# EasyEDA Pro project kuafu01_030内部老化方案.eprj, board PCB4 (continued)
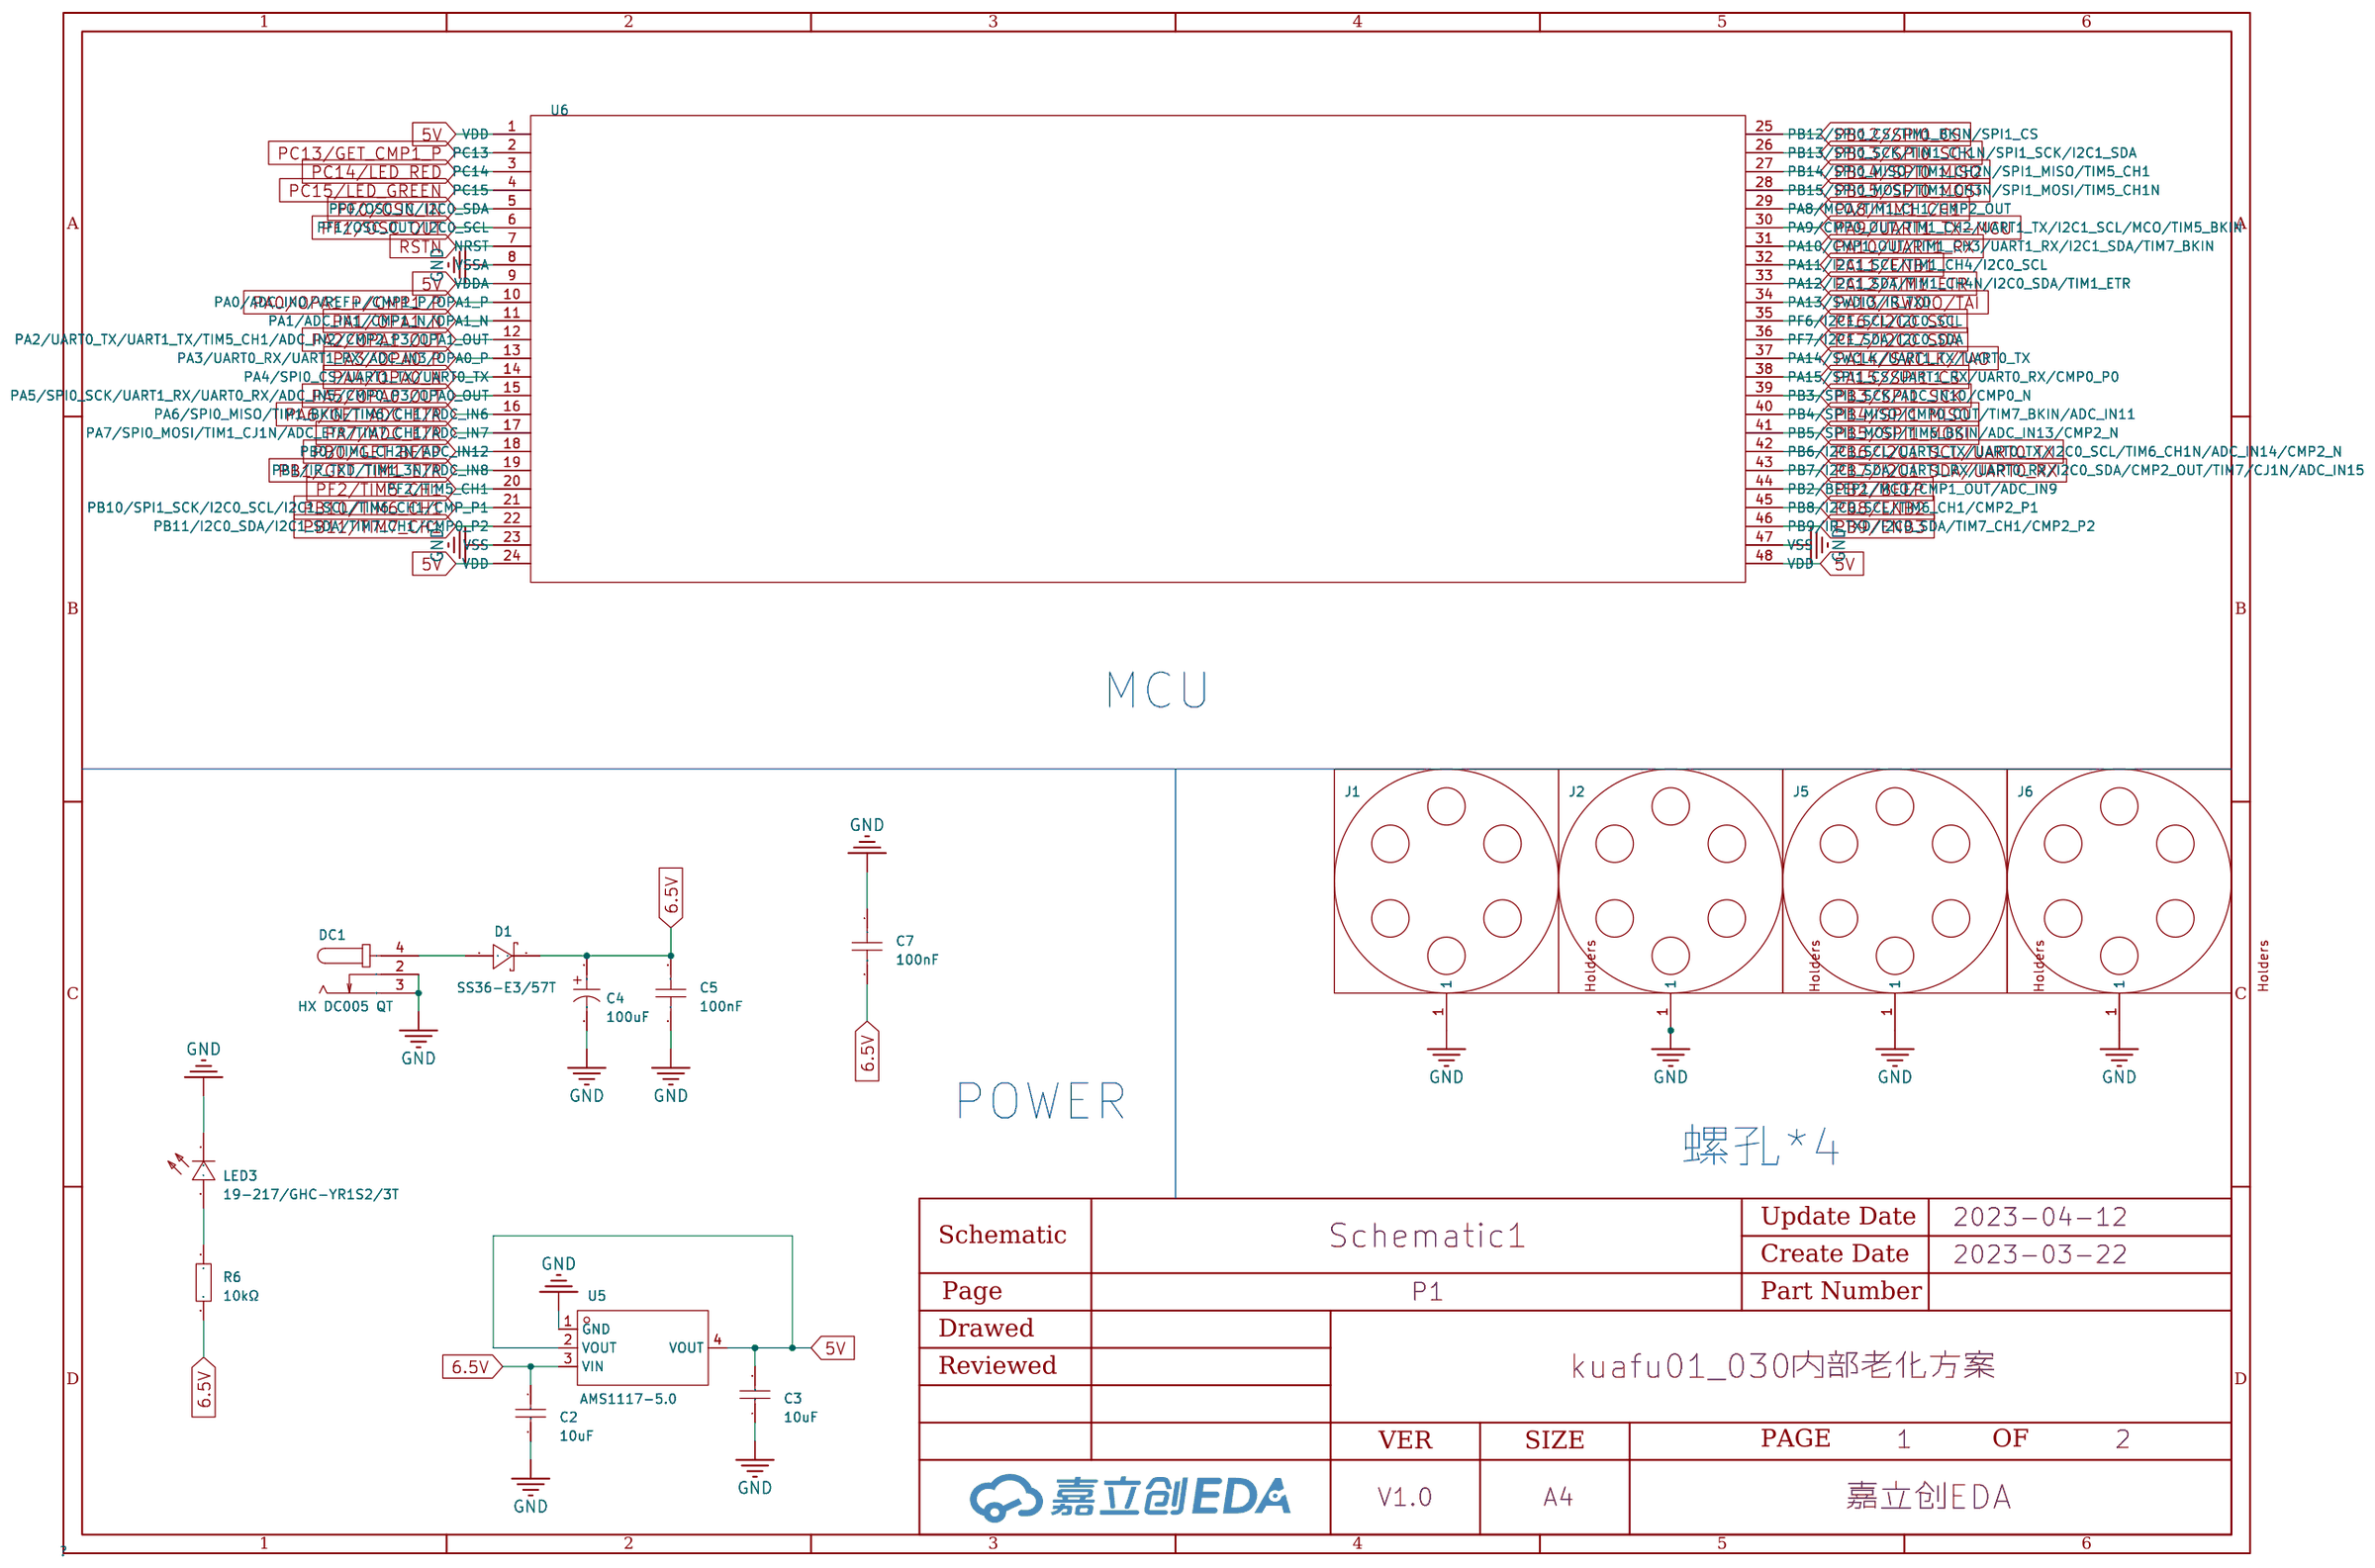
[diagram p0: P1]
## Routing (per net, layer and track width the routed paths; a pad name or vN(x,y) marks a point on that pad's centre or on a via; arc(x,y) is an arc through that point) (continued)
v1(231.39,237.24) v1(231.39,236.47) v1(231.39,235.71) v1(231.39,231.14) v1(231.39,230.38) v1(231.39,229.62) v1(231.39,223.52) v1(231.39,222.76) v1(231.39,222) v1(231.39,186.44) v1(231.39,185.67) v1(231.39,184.91) v1(231.39,180.34) v1(231.39,179.58) v1(231.39,178.82) v1(231.39,172.72) v1(231.39,171.96) v1(231.39,171.2) v1(231.39,135.64) v1(231.39,134.87) v1(231.39,134.11) v1(231.39,129.54) v1(231.39,128.78) v1(231.39,128.02) v1(231.39,121.92) v1(231.39,121.16) v1(231.39,120.4) v1(231.39,84.84) v1(231.39,84.07) v1(231.39,83.31) v1(231.39,78.74) v1(231.39,77.98) v1(231.39,77.22) v1(231.39,71.12) v1(231.39,70.36) v1(231.39,69.6) v1(231.39,34.04) v1(231.39,33.27) v1(231.39,32.51) v1(231.39,27.94) v1(231.39,27.18) v1(231.39,26.42) v1(231.39,20.32) v1(231.39,19.56) v1(231.39,18.8) v1(232.16,338.84) v1(232.16,338.07) v1(232.16,337.31) v1(232.16,332.74) v1(232.16,331.98) v1(232.16,331.22) v1(232.16,325.12) v1(232.16,324.36) v1(232.16,323.6) v1(232.16,288.04) v1(232.16,287.27) v1(232.16,286.51) v1(232.16,281.94) v1(232.16,281.18) v1(232.16,280.42) v1(232.16,274.32) v1(232.16,273.56) v1(232.16,272.8) v1(232.16,237.24) v1(232.16,236.47) v1(232.16,235.71) v1(232.16,231.14) v1(232.16,230.38) v1(232.16,229.62) v1(232.16,223.52) v1(232.16,222.76) v1(232.16,222) v1(232.16,186.44) v1(232.16,185.67) v1(232.16,184.91) v1(232.16,180.34) v1(232.16,179.58) v1(232.16,178.82) v1(232.16,172.72) v1(232.16,171.96) v1(232.16,171.2) v1(232.16,135.64) v1(232.16,134.87) v1(232.16,134.11) v1(232.16,129.54) v1(232.16,128.78) v1(232.16,128.02) v1(232.16,121.92) v1(232.16,121.16) v1(232.16,120.4) v1(232.16,84.84) v1(232.16,84.07) v1(232.16,83.31) v1(232.16,78.74) v1(232.16,77.98) v1(232.16,77.22) v1(232.16,71.12) v1(232.16,70.36) v1(232.16,69.6) v1(232.16,34.04) v1(232.16,33.27) v1(232.16,32.51) v1(232.16,27.94) v1(232.16,27.18) v1(232.16,26.42) v1(232.16,20.32) v1(232.16,19.56) v1(232.16,18.8) v1(232.66,345.95) v1(232.66,345.19) v1(232.66,344.42) v1(232.66,295.15) v1(232.66,294.39) v1(232.66,293.62) v1(232.66,244.35) v1(232.66,243.59) v1(232.66,242.82) v1(232.66,193.55) v1(232.66,192.79) v1(232.66,192.02) v1(232.66,142.75) v1(232.66,141.99) v1(232.66,141.22) v1(232.66,91.95) v1(232.66,91.19) v1(232.66,90.42) v1(232.66,41.15) v1(232.66,40.39) v1(232.66,39.62) v1(233.43,345.95) v1(233.43,345.19) v1(233.43,344.42) v1(233.43,295.15) v1(233.43,294.39) v1(233.43,293.62) v1(233.43,244.35) v1(233.43,243.59) v1(233.43,242.82) v1(233.43,193.55) v1(233.43,192.79) v1(233.43,192.02) v1(233.43,142.75) v1(233.43,141.99) v1(233.43,141.22) v1(233.43,91.95) v1(233.43,91.19) v1(233.43,90.42) v1(233.43,41.15) v1(233.43,40.39) v1(233.43,39.62) v1(234.19,352.04) v1(234.19,351.28) v1(234.19,350.52) v1(234.19,345.95) v1(234.19,345.19) v1(234.19,344.42) v1(234.19,301.24) v1(234.19,300.48) v1(234.19,299.72) v1(234.19,295.15) v1(234.19,294.39) v1(234.19,293.62) v1(234.19,250.44) v1(234.19,249.68) v1(234.19,248.92) v1(234.19,244.35) v1(234.19,243.59) v1(234.19,242.82) v1(234.19,199.64) v1(234.19,198.88) v1(234.19,198.12) v1(234.19,193.55) v1(234.19,192.79) v1(234.19,192.02) v1(234.19,148.84) v1(234.19,148.08) v1(234.19,147.32) v1(234.19,142.75) v1(234.19,141.99) v1(234.19,141.22) v1(234.19,98.04) v1(234.19,97.28) v1(234.19,96.52) v1(234.19,91.95) v1(234.19,91.19) v1(234.19,90.42) v1(234.19,47.24) v1(234.19,46.48) v1(234.19,45.72) v1(234.19,41.15) v1(234.19,40.39) v1(234.19,39.62) v1(234.95,352.04) v1(234.95,351.28) v1(234.95,350.52) v1(234.95,301.24) v1(234.95,300.48) v1(234.95,299.72) v1(234.95,250.44) v1(234.95,249.68) v1(234.95,248.92) v1(234.95,199.64) v1(234.95,198.88) v1(234.95,198.12) v1(234.95,148.84) v1(234.95,148.08) v1(234.95,147.32) v1(234.95,98.04) v1(234.95,97.28) v1(234.95,96.52) v1(234.95,47.24) v1(234.95,46.48) v1(234.95,45.72) v1(235.71,352.04) v1(235.71,351.28) v1(235.71,350.52) v1(235.71,301.24) v1(235.71,300.48) v1(235.71,299.72) v1(235.71,250.44) v1(235.71,249.68) v1(235.71,248.92) v1(235.71,199.64) v1(235.71,198.88) v1(235.71,198.12) v1(235.71,148.84) v1(235.71,148.08) v1(235.71,147.32) v1(235.71,98.04) v1(235.71,97.28) v1(235.71,96.52) v1(235.71,47.24) v1(235.71,46.48) v1(235.71,45.72) v1(236.22,358.14) v1(236.22,357.38) v1(236.22,356.62) v1(236.22,319.02) v1(236.22,318.26) v1(236.22,317.5) v1(236.22,307.34) v1(236.22,306.58) v1(236.22,305.82) v1(236.22,268.22) v1(236.22,267.46) v1(236.22,266.7) v1(236.22,256.54) v1(236.22,255.78) v1(236.22,255.02) v1(236.22,217.42) v1(236.22,216.66) v1(236.22,215.9) v1(236.22,205.74) v1(236.22,204.98) v1(236.22,204.22) v1(236.22,166.62) v1(236.22,165.86) v1(236.22,165.1) v1(236.22,154.94) v1(236.22,154.18) v1(236.22,153.42) v1(236.22,115.82) v1(236.22,115.06) v1(236.22,114.3) v1(236.22,104.14) v1(236.22,103.38) v1(236.22,102.62) v1(236.22,65.02) v1(236.22,64.26) v1(236.22,63.5) v1(236.22,53.34) v1(236.22,52.58) v1(236.22,51.82) v1(236.22,14.22) v1(236.22,13.46) v1(236.22,12.7) v1(236.98,358.14) v1(236.98,357.38) v1(236.98,356.62) v1(236.98,319.02) v1(236.98,318.26) v1(236.98,317.5) v1(236.98,307.34) v1(236.98,306.58) v1(236.98,305.82) v1(236.98,268.22) v1(236.98,267.46) v1(236.98,266.7) v1(236.98,256.54) v1(236.98,255.78) v1(236.98,255.02) v1(236.98,217.42) v1(236.98,216.66) v1(236.98,215.9) v1(236.98,205.74) v1(236.98,204.98) v1(236.98,204.22) v1(236.98,166.62) v1(236.98,165.86) v1(236.98,165.1) v1(236.98,154.94) v1(236.98,154.18) v1(236.98,153.42) v1(236.98,115.82) v1(236.98,115.06) v1(236.98,114.3) v1(236.98,104.14) v1(236.98,103.38) v1(236.98,102.62) v1(236.98,65.02) v1(236.98,64.26) v1(236.98,63.5) v1(236.98,53.34) v1(236.98,52.58) v1(236.98,51.82) v1(236.98,14.22) v1(236.98,13.46) v1(236.98,12.7) v1(237.74,358.14) v1(237.74,357.38) v1(237.74,356.62) v1(237.74,319.02) v1(237.74,318.26) v1(237.74,317.5) v1(237.74,307.34) v1(237.74,306.58) v1(237.74,305.82) v1(237.74,268.22) v1(237.74,267.46) v1(237.74,266.7) v1(237.74,256.54) v1(237.74,255.78) v1(237.74,255.02) v1(237.74,217.42) v1(237.74,216.66) v1(237.74,215.9) v1(237.74,205.74) v1(237.74,204.98) v1(237.74,204.22) v1(237.74,166.62) v1(237.74,165.86) v1(237.74,165.1) v1(237.74,154.94) v1(237.74,154.18) v1(237.74,153.42) v1(237.74,115.82) v1(237.74,115.06) v1(237.74,114.3) v1(237.74,104.14) v1(237.74,103.38) v1(237.74,102.62) v1(237.74,65.02) v1(237.74,64.26) v1(237.74,63.5) v1(237.74,53.34) v1(237.74,52.58) v1(237.74,51.82) v1(237.74,14.22) v1(237.74,13.46) v1(237.74,12.7) v1(266.19,358.14) v1(266.19,357.38) v1(266.19,356.62) v1(266.19,319.02) v1(266.19,318.26) v1(266.19,317.5) v1(266.19,307.34) v1(266.19,306.58) v1(266.19,305.82) v1(266.19,268.22) v1(266.19,267.46) v1(266.19,266.7) v1(266.19,256.54) v1(266.19,255.78) v1(266.19,255.02) v1(266.19,217.42) v1(266.19,216.66) v1(266.19,215.9) v1(266.19,205.74) v1(266.19,204.98) v1(266.19,204.22) v1(266.19,166.62) v1(266.19,165.86) v1(266.19,165.1) v1(266.19,154.94) v1(266.19,154.18) v1(266.19,153.42) v1(266.19,115.82) v1(266.19,115.06) v1(266.19,114.3) v1(266.19,104.14) v1(266.19,103.38) v1(266.19,102.62) v1(266.19,65.02) v1(266.19,64.26) v1(266.19,63.5) v1(266.19,53.34) v1(266.19,52.58) v1(266.19,51.82) v1(266.19,14.22) v1(266.19,13.46) v1(266.19,12.7) v1(266.95,358.14) v1(266.95,357.38) v1(266.95,356.62) v1(266.95,319.02) v1(266.95,318.26) v1(266.95,317.5) v1(266.95,307.34) v1(266.95,306.58) v1(266.95,305.82) v1(266.95,268.22) v1(266.95,267.46) v1(266.95,266.7) v1(266.95,256.54) v1(266.95,255.78) v1(266.95,255.02) v1(266.95,217.42) v1(266.95,216.66) v1(266.95,215.9) v1(266.95,205.74) v1(266.95,204.98) v1(266.95,204.22) v1(266.95,166.62) v1(266.95,165.86) v1(266.95,165.1) v1(266.95,154.94) v1(266.95,154.18) v1(266.95,153.42) v1(266.95,115.82) v1(266.95,115.06) v1(266.95,114.3) v1(266.95,104.14) v1(266.95,103.38) v1(266.95,102.62) v1(266.95,65.02) v1(266.95,64.26) v1(266.95,63.5) v1(266.95,53.34) v1(266.95,52.58) v1(266.95,51.82) v1(266.95,14.22) v1(266.95,13.46) v1(266.95,12.7) v1(267.72,358.14) v1(267.72,357.38) v1(267.72,356.62) v1(267.72,319.02) v1(267.72,318.26) v1(267.72,317.5) v1(267.72,307.34) v1(267.72,306.58) v1(267.72,305.82) v1(267.72,268.22) v1(267.72,267.46) v1(267.72,266.7) v1(267.72,256.54) v1(267.72,255.78) v1(267.72,255.02) v1(267.72,217.42) v1(267.72,216.66) v1(267.72,215.9) v1(267.72,205.74) v1(267.72,204.98) v1(267.72,204.22) v1(267.72,166.62) v1(267.72,165.86) v1(267.72,165.1) v1(267.72,154.94) v1(267.72,154.18) v1(267.72,153.42) v1(267.72,115.82) v1(267.72,115.06) v1(267.72,114.3) v1(267.72,104.14) v1(267.72,103.38) v1(267.72,102.62) v1(267.72,65.02) v1(267.72,64.26) v1(267.72,63.5) v1(267.72,53.34) v1(267.72,52.58) v1(267.72,51.82) v1(267.72,14.22) v1(267.72,13.46) v1(267.72,12.7) v1(268.73,352.04) v1(268.73,351.28) v1(268.73,350.52) v1(268.73,301.24) v1(268.73,300.48) v1(268.73,299.72) v1(268.73,250.44) v1(268.73,249.68) v1(268.73,248.92) v1(268.73,199.64) v1(268.73,198.88) v1(268.73,198.12) v1(268.73,148.84) v1(268.73,148.08) v1(268.73,147.32) v1(268.73,98.04) v1(268.73,97.28) v1(268.73,96.52) v1(268.73,47.24) v1(268.73,46.48) v1(268.73,45.72) v1(269.49,352.04) v1(269.49,351.28) v1(269.49,350.52) v1(269.49,301.24) v1(269.49,300.48) v1(269.49,299.72) v1(269.49,250.44) v1(269.49,249.68) v1(269.49,248.92) v1(269.49,199.64) v1(269.49,198.88) v1(269.49,198.12) v1(269.49,148.84) v1(269.49,148.08) v1(269.49,147.32) v1(269.49,98.04) v1(269.49,97.28) v1(269.49,96.52) v1(269.49,47.24) v1(269.49,46.48) v1(269.49,45.72) v1(270.26,352.04) v1(270.26,351.28) v1(270.26,350.52) v1(270.26,301.24) v1(270.26,300.48) v1(270.26,299.72) v1(270.26,250.44) v1(270.26,249.68) v1(270.26,248.92) v1(270.26,199.64) v1(270.26,198.88) v1(270.26,198.12) v1(270.26,148.84) v1(270.26,148.08) v1(270.26,147.32) v1(270.26,98.04) v1(270.26,97.28) v1(270.26,96.52) v1(270.26,47.24) v1(270.26,46.48) v1(270.26,45.72) v1(271.78,345.95) v1(271.78,345.19) v1(271.78,344.42) v1(271.78,323.6) v1(271.78,322.83) v1(271.78,322.07) v1(271.78,295.15) v1(271.78,294.39) v1(271.78,293.62) v1(271.78,272.8) v1(271.78,272.03) v1(271.78,271.27) v1(271.78,244.35) v1(271.78,243.59) v1(271.78,242.82) v1(271.78,222) v1(271.78,221.23) v1(271.78,220.47) v1(271.78,193.55) v1(271.78,192.79) v1(271.78,192.02) v1(271.78,171.2) v1(271.78,170.43) v1(271.78,169.67) v1(271.78,142.75) v1(271.78,141.99) v1(271.78,141.22) v1(271.78,120.4) v1(271.78,119.63) v1(271.78,118.87) v1(271.78,91.95) v1(271.78,91.19) v1(271.78,90.42) v1(271.78,69.6) v1(271.78,68.83) v1(271.78,68.07) v1(271.78,41.15) v1(271.78,40.39) v1(271.78,39.62) v1(271.78,18.8) v1(271.78,18.03) v1(271.78,17.27) v1(272.54,345.95) v1(272.54,345.19) v1(272.54,344.42) v1(272.54,323.6) v1(272.54,322.83) v1(272.54,322.07) v1(272.54,295.15) v1(272.54,294.39) v1(272.54,293.62) v1(272.54,272.8) v1(272.54,272.03) v1(272.54,271.27) v1(272.54,244.35) v1(272.54,243.59) v1(272.54,242.82) v1(272.54,222) v1(272.54,221.23) v1(272.54,220.47) v1(272.54,193.55) v1(272.54,192.79) v1(272.54,192.02) v1(272.54,171.2) v1(272.54,170.43) v1(272.54,169.67) v1(272.54,142.75) v1(272.54,141.99) v1(272.54,141.22) v1(272.54,120.4) v1(272.54,119.63) v1(272.54,118.87) v1(272.54,91.95) v1(272.54,91.19) v1(272.54,90.42) v1(272.54,69.6) v1(272.54,68.83) v1(272.54,68.07) v1(272.54,41.15) v1(272.54,40.39) v1(272.54,39.62) v1(272.54,18.8) v1(272.54,18.03) v1(272.54,17.27) v1(273.3,345.95) v1(273.3,345.19) v1(273.3,344.42) v1(273.3,323.6) v1(273.3,322.83) v1(273.3,322.07) v1(273.3,295.15) v1(273.3,294.39) v1(273.3,293.62) v1(273.3,272.8) v1(273.3,272.03) v1(273.3,271.27) v1(273.3,244.35) v1(273.3,243.59) v1(273.3,242.82) v1(273.3,222) v1(273.3,221.23) v1(273.3,220.47) v1(273.3,193.55) v1(273.3,192.79) v1(273.3,192.02) v1(273.3,171.2) v1(273.3,170.43) v1(273.3,169.67) v1(273.3,142.75) v1(273.3,141.99) v1(273.3,141.22) v1(273.3,120.4) v1(273.3,119.63) v1(273.3,118.87) v1(273.3,91.95) v1(273.3,91.19) v1(273.3,90.42) v1(273.3,69.6) v1(273.3,68.83) v1(273.3,68.07) v1(273.3,41.15) v1(273.3,40.39) v1(273.3,39.62) v1(273.3,18.8) v1(273.3,18.03) v1(273.3,17.27) v1(274.83,338.84) v1(274.83,338.07) v1(274.83,337.31) v1(274.83,329.18) v1(274.83,328.42) v1(274.83,327.66) v1(274.83,288.04) v1(274.83,287.27) v1(274.83,286.51) v1(274.83,278.38) v1(274.83,277.62) v1(274.83,276.86) v1(274.83,237.24) v1(274.83,236.47) v1(274.83,235.71) v1(274.83,227.58) v1(274.83,226.82) v1(274.83,226.06) v1(274.83,186.44) v1(274.83,185.67) v1(274.83,184.91) v1(274.83,176.78) v1(274.83,176.02) v1(274.83,175.26) v1(274.83,135.64) v1(274.83,134.87) v1(274.83,134.11) v1(274.83,125.98) v1(274.83,125.22) v1(274.83,124.46) v1(274.83,84.84) v1(274.83,84.07) v1(274.83,83.31) v1(274.83,75.18) v1(274.83,74.42) v1(274.83,73.66) v1(274.83,34.04) v1(274.83,33.27) v1(274.83,32.51) v1(274.83,24.38) v1(274.83,23.62) v1(274.83,22.86) v1(275.59,338.84) v1(275.59,338.07) v1(275.59,337.31) v1(275.59,329.18) v1(275.59,328.42) v1(275.59,327.66) v1(275.59,288.04) v1(275.59,287.27) v1(275.59,286.51) v1(275.59,278.38) v1(275.59,277.62) v1(275.59,276.86) v1(275.59,237.24) v1(275.59,236.47) v1(275.59,235.71) v1(275.59,227.58) v1(275.59,226.82) v1(275.59,226.06) v1(275.59,186.44) v1(275.59,185.67) v1(275.59,184.91) v1(275.59,176.78) v1(275.59,176.02) v1(275.59,175.26) v1(275.59,135.64) v1(275.59,134.87) v1(275.59,134.11) v1(275.59,125.98) v1(275.59,125.22) v1(275.59,124.46) v1(275.59,84.84) v1(275.59,84.07) v1(275.59,83.31) v1(275.59,75.18) v1(275.59,74.42) v1(275.59,73.66) v1(275.59,34.04) v1(275.59,33.27) v1(275.59,32.51) v1(275.59,24.38) v1(275.59,23.62) v1(275.59,22.86) v1(276.35,338.84) v1(276.35,338.07) v1(276.35,337.31) v1(276.35,329.18) v1(276.35,328.42) v1(276.35,327.66) v1(276.35,288.04) v1(276.35,287.27) v1(276.35,286.51) v1(276.35,278.38) v1(276.35,277.62) v1(276.35,276.86) v1(276.35,237.24) v1(276.35,236.47) v1(276.35,235.71) v1(276.35,227.58) v1(276.35,226.82) v1(276.35,226.06) v1(276.35,186.44) v1(276.35,185.67) v1(276.35,184.91) v1(276.35,176.78) v1(276.35,176.02) v1(276.35,175.26) v1(276.35,135.64) v1(276.35,134.87) v1(276.35,134.11) v1(276.35,125.98) v1(276.35,125.22) v1(276.35,124.46) v1(276.35,84.84) v1(276.35,84.07) v1(276.35,83.31) v1(276.35,75.18) v1(276.35,74.42) v1(276.35,73.66) v1(276.35,34.04) v1(276.35,33.27) v1(276.35,32.51) v1(276.35,24.38) v1(276.35,23.62) v1(276.35,22.86) v1(281.43,338.84) v1(281.43,338.07) v1(281.43,337.31) v1(281.43,332.74) v1(281.43,331.98) v1(281.43,331.22) v1(281.43,325.12) v1(281.43,324.36) v1(281.43,323.6) v1(281.43,288.04) v1(281.43,287.27) v1(281.43,286.51) v1(281.43,281.94) v1(281.43,281.18) v1(281.43,280.42) v1(281.43,274.32) v1(281.43,273.56) v1(281.43,272.8) v1(281.43,237.24) v1(281.43,236.47) v1(281.43,235.71) v1(281.43,231.14) v1(281.43,230.38) v1(281.43,229.62) v1(281.43,223.52) v1(281.43,222.76) v1(281.43,222) v1(281.43,186.44) v1(281.43,185.67) v1(281.43,184.91) v1(281.43,180.34) v1(281.43,179.58) v1(281.43,178.82) v1(281.43,172.72) v1(281.43,171.96) v1(281.43,171.2) v1(281.43,135.64) v1(281.43,134.87) v1(281.43,134.11) v1(281.43,129.54) v1(281.43,128.78) v1(281.43,128.02) v1(281.43,121.92) v1(281.43,121.16) v1(281.43,120.4) v1(281.43,84.84) v1(281.43,84.07) v1(281.43,83.31) v1(281.43,78.74) v1(281.43,77.98) v1(281.43,77.22) v1(281.43,71.12) v1(281.43,70.36) v1(281.43,69.6) v1(282.19,338.84) v1(282.19,338.07) v1(282.19,337.31) v1(282.19,332.74) v1(282.19,331.98) v1(282.19,331.22) v1(282.19,325.12) v1(282.19,324.36) v1(282.19,323.6) v1(282.19,288.04) v1(282.19,287.27) v1(282.19,286.51) v1(282.19,281.94) v1(282.19,281.18) v1(282.19,280.42) v1(282.19,274.32) v1(282.19,273.56) v1(282.19,272.8) v1(282.19,237.24) v1(282.19,236.47) v1(282.19,235.71) v1(282.19,231.14) v1(282.19,230.38) v1(282.19,229.62) v1(282.19,223.52) v1(282.19,222.76) v1(282.19,222) v1(282.19,186.44) v1(282.19,185.67) v1(282.19,184.91) v1(282.19,180.34) v1(282.19,179.58) v1(282.19,178.82) v1(282.19,172.72) v1(282.19,171.96) v1(282.19,171.2) v1(282.19,135.64) v1(282.19,134.87) v1(282.19,134.11) v1(282.19,129.54) v1(282.19,128.78) v1(282.19,128.02) v1(282.19,121.92) v1(282.19,121.16) v1(282.19,120.4) v1(282.19,84.84) v1(282.19,84.07) v1(282.19,83.31) v1(282.19,78.74) v1(282.19,77.98) v1(282.19,77.22) v1(282.19,71.12) v1(282.19,70.36) v1(282.19,69.6) v1(282.96,338.84) v1(282.96,338.07) v1(282.96,337.31) v1(282.96,332.74) v1(282.96,331.98) v1(282.96,331.22) v1(282.96,325.12) v1(282.96,324.36) v1(282.96,323.6) v1(282.96,288.04) v1(282.96,287.27) v1(282.96,286.51) v1(282.96,281.94) v1(282.96,281.18) v1(282.96,280.42) v1(282.96,274.32) v1(282.96,273.56) v1(282.96,272.8) v1(282.96,237.24) v1(282.96,236.47) v1(282.96,235.71) v1(282.96,231.14) v1(282.96,230.38) v1(282.96,229.62) v1(282.96,223.52) v1(282.96,222.76) v1(282.96,222) v1(282.96,186.44) v1(282.96,185.67) v1(282.96,184.91) v1(282.96,180.34) v1(282.96,179.58) v1(282.96,178.82) v1(282.96,172.72) v1(282.96,171.96) v1(282.96,171.2) v1(282.96,135.64) v1(282.96,134.87) v1(282.96,134.11) v1(282.96,129.54) v1(282.96,128.78) v1(282.96,128.02) v1(282.96,121.92) v1(282.96,121.16) v1(282.96,120.4) v1(282.96,84.84) v1(282.96,84.07) v1(282.96,83.31) v1(282.96,78.74) v1(282.96,77.98) v1(282.96,77.22) v1(282.96,71.12) v1(282.96,70.36) v1(282.96,69.6) v1(283.46,345.95) v1(283.46,345.19) v1(283.46,344.42) v1(283.46,295.15) v1(283.46,294.39) v1(283.46,293.62) v1(283.46,244.35) v1(283.46,243.59) v1(283.46,242.82) v1(283.46,193.55) v1(283.46,192.79) v1(283.46,192.02) v1(283.46,142.75) v1(283.46,141.99) v1(283.46,141.22) v1(283.46,91.95) v1(283.46,91.19) v1(283.46,90.42) v1(284.23,345.95) v1(284.23,345.19) v1(284.23,344.42) v1(284.23,295.15) v1(284.23,294.39) v1(284.23,293.62) v1(284.23,244.35) v1(284.23,243.59) v1(284.23,242.82) v1(284.23,193.55) v1(284.23,192.79) v1(284.23,192.02) v1(284.23,142.75) v1(284.23,141.99) v1(284.23,141.22) v1(284.23,91.95) v1(284.23,91.19) v1(284.23,90.42) v1(284.99,352.04) v1(284.99,351.28) v1(284.99,350.52) v1(284.99,345.95) v1(284.99,345.19) v1(284.99,344.42) v1(284.99,301.24) v1(284.99,300.48) v1(284.99,299.72) v1(284.99,295.15) v1(284.99,294.39) v1(284.99,293.62) v1(284.99,250.44) v1(284.99,249.68) v1(284.99,248.92) v1(284.99,244.35) v1(284.99,243.59) v1(284.99,242.82) v1(284.99,199.64) v1(284.99,198.88) v1(284.99,198.12) v1(284.99,193.55) v1(284.99,192.79) v1(284.99,192.02) v1(284.99,148.84) v1(284.99,148.08) v1(284.99,147.32) v1(284.99,142.75) v1(284.99,141.99) v1(284.99,141.22) v1(284.99,98.04) v1(284.99,97.28) v1(284.99,96.52) v1(284.99,91.95) v1(284.99,91.19) v1(284.99,90.42) v1(285.75,352.04) v1(285.75,351.28) v1(285.75,350.52) v1(285.75,301.24) v1(285.75,300.48) v1(285.75,299.72) v1(285.75,250.44) v1(285.75,249.68) v1(285.75,248.92) v1(285.75,199.64) v1(285.75,198.88) v1(285.75,198.12) v1(285.75,148.84) v1(285.75,148.08) v1(285.75,147.32) v1(285.75,98.04) v1(285.75,97.28) v1(285.75,96.52) v1(286.51,352.04) v1(286.51,351.28) v1(286.51,350.52) v1(286.51,301.24) v1(286.51,300.48) v1(286.51,299.72) v1(286.51,250.44) v1(286.51,249.68) v1(286.51,248.92) v1(286.51,199.64) v1(286.51,198.88) v1(286.51,198.12) v1(286.51,148.84) v1(286.51,148.08) v1(286.51,147.32) v1(286.51,98.04) v1(286.51,97.28) v1(286.51,96.52) v1(287.02,358.14) v1(287.02,357.38) v1(287.02,356.62) v1(287.02,319.02) v1(287.02,318.26) v1(287.02,317.5) v1(287.02,307.34) v1(287.02,306.58) v1(287.02,305.82) v1(287.02,268.22) v1(287.02,267.46) v1(287.02,266.7) v1(287.02,256.54) v1(287.02,255.78) v1(287.02,255.02) v1(287.02,217.42) v1(287.02,216.66) v1(287.02,215.9) v1(287.02,205.74) v1(287.02,204.98) v1(287.02,204.22) v1(287.02,166.62) v1(287.02,165.86) v1(287.02,165.1) v1(287.02,154.94) v1(287.02,154.18) v1(287.02,153.42) v1(287.02,115.82) v1(287.02,115.06) v1(287.02,114.3) v1(287.02,104.14) v1(287.02,103.38) v1(287.02,102.62) v1(287.02,65.02) v1(287.02,64.26) v1(287.02,63.5) v1(287.78,358.14) v1(287.78,357.38) v1(287.78,356.62) v1(287.78,319.02) v1(287.78,318.26) v1(287.78,317.5) v1(287.78,307.34) v1(287.78,306.58) v1(287.78,305.82) v1(287.78,268.22) v1(287.78,267.46) v1(287.78,266.7) v1(287.78,256.54) v1(287.78,255.78) v1(287.78,255.02) v1(287.78,217.42) v1(287.78,216.66) v1(287.78,215.9) v1(287.78,205.74) v1(287.78,204.98) v1(287.78,204.22) v1(287.78,166.62) v1(287.78,165.86) v1(287.78,165.1) v1(287.78,154.94) v1(287.78,154.18) v1(287.78,153.42) v1(287.78,115.82) v1(287.78,115.06) v1(287.78,114.3) v1(287.78,104.14) v1(287.78,103.38) v1(287.78,102.62) v1(287.78,65.02) v1(287.78,64.26) v1(287.78,63.5) v1(288.54,358.14) v1(288.54,357.38) v1(288.54,356.62) v1(288.54,319.02) v1(288.54,318.26) v1(288.54,317.5) v1(288.54,307.34) v1(288.54,306.58) v1(288.54,305.82) v1(288.54,268.22) v1(288.54,267.46) v1(288.54,266.7) v1(288.54,256.54) v1(288.54,255.78) v1(288.54,255.02) v1(288.54,217.42) v1(288.54,216.66) v1(288.54,215.9) v1(288.54,205.74) v1(288.54,204.98) v1(288.54,204.22) v1(288.54,166.62) v1(288.54,165.86) v1(288.54,165.1) v1(288.54,154.94) v1(288.54,154.18) v1(288.54,153.42) v1(288.54,115.82) v1(288.54,115.06) v1(288.54,114.3) v1(288.54,104.14) v1(288.54,103.38) v1(288.54,102.62) v1(288.54,65.02) v1(288.54,64.26) v1(288.54,63.5) v1(316.99,358.14) v1(316.99,357.38) v1(316.99,356.62) v1(316.99,319.02) v1(316.99,318.26) v1(316.99,317.5) v1(316.99,307.34) v1(316.99,306.58) v1(316.99,305.82) v1(316.99,268.22) v1(316.99,267.46) v1(316.99,266.7) v1(316.99,256.54) v1(316.99,255.78) v1(316.99,255.02) v1(316.99,217.42) v1(316.99,216.66) v1(316.99,215.9) v1(316.99,205.74) v1(316.99,204.98) v1(316.99,204.22) v1(316.99,166.62) v1(316.99,165.86) v1(316.99,165.1) v1(316.99,154.94) v1(316.99,154.18) v1(316.99,153.42) v1(316.99,115.82) v1(316.99,115.06) v1(316.99,114.3) v1(316.99,104.14) v1(316.99,103.38) v1(316.99,102.62) v1(316.99,65.02) v1(316.99,64.26) v1(316.99,63.5) v1(317.75,358.14) v1(317.75,357.38) v1(317.75,356.62) v1(317.75,319.02) v1(317.75,318.26) v1(317.75,317.5) v1(317.75,307.34) v1(317.75,306.58) v1(317.75,305.82) v1(317.75,268.22) v1(317.75,267.46) v1(317.75,266.7) v1(317.75,256.54) v1(317.75,255.78) v1(317.75,255.02) v1(317.75,217.42) v1(317.75,216.66) v1(317.75,215.9) v1(317.75,205.74) v1(317.75,204.98) v1(317.75,204.22) v1(317.75,166.62) v1(317.75,165.86) v1(317.75,165.1) v1(317.75,154.94) v1(317.75,154.18) v1(317.75,153.42) v1(317.75,115.82) v1(317.75,115.06) v1(317.75,114.3) v1(317.75,104.14) v1(317.75,103.38) v1(317.75,102.62) v1(317.75,65.02) v1(317.75,64.26) v1(317.75,63.5) v1(318.52,358.14) v1(318.52,357.38) v1(318.52,356.62) v1(318.52,319.02) v1(318.52,318.26) v1(318.52,317.5) v1(318.52,307.34) v1(318.52,306.58) v1(318.52,305.82) v1(318.52,268.22) v1(318.52,267.46) v1(318.52,266.7) v1(318.52,256.54) v1(318.52,255.78) v1(318.52,255.02) v1(318.52,217.42) v1(318.52,216.66) v1(318.52,215.9) v1(318.52,205.74) v1(318.52,204.98) v1(318.52,204.22) v1(318.52,166.62) v1(318.52,165.86) v1(318.52,165.1) v1(318.52,154.94) v1(318.52,154.18) v1(318.52,153.42) v1(318.52,115.82) v1(318.52,115.06) v1(318.52,114.3) v1(318.52,104.14) v1(318.52,103.38) v1(318.52,102.62) v1(318.52,65.02) v1(318.52,64.26) v1(318.52,63.5) v1(319.53,352.04) v1(319.53,351.28) v1(319.53,350.52) v1(319.53,301.24) v1(319.53,300.48) v1(319.53,299.72) v1(319.53,250.44) v1(319.53,249.68) v1(319.53,248.92) v1(319.53,199.64) v1(319.53,198.88) v1(319.53,198.12) v1(319.53,148.84) v1(319.53,148.08) v1(319.53,147.32) v1(319.53,98.04) v1(319.53,97.28) v1(319.53,96.52) v1(320.29,352.04) v1(320.29,351.28) v1(320.29,350.52) v1(320.29,301.24) v1(320.29,300.48) v1(320.29,299.72) v1(320.29,250.44) v1(320.29,249.68) v1(320.29,248.92) v1(320.29,199.64) v1(320.29,198.88) v1(320.29,198.12) v1(320.29,148.84) v1(320.29,148.08) v1(320.29,147.32) v1(320.29,98.04) v1(320.29,97.28) v1(320.29,96.52) v1(321.06,352.04) v1(321.06,351.28) v1(321.06,350.52) v1(321.06,301.24) v1(321.06,300.48) v1(321.06,299.72) v1(321.06,250.44) v1(321.06,249.68) v1(321.06,248.92) v1(321.06,199.64) v1(321.06,198.88) v1(321.06,198.12) v1(321.06,148.84) v1(321.06,148.08) v1(321.06,147.32) v1(321.06,98.04) v1(321.06,97.28) v1(321.06,96.52) v1(322.58,345.95) v1(322.58,345.19) v1(322.58,344.42) v1(322.58,323.6) v1(322.58,322.83) v1(322.58,322.07) v1(322.58,295.15) v1(322.58,294.39) v1(322.58,293.62) v1(322.58,272.8) v1(322.58,272.03) v1(322.58,271.27) v1(322.58,244.35) v1(322.58,243.59) v1(322.58,242.82) v1(322.58,222) v1(322.58,221.23) v1(322.58,220.47) v1(322.58,193.55) v1(322.58,192.79) v1(322.58,192.02) v1(322.58,171.2) v1(322.58,170.43) v1(322.58,169.67) v1(322.58,142.75) v1(322.58,141.99) v1(322.58,141.22) v1(322.58,120.4) v1(322.58,119.63) v1(322.58,118.87) v1(322.58,91.95) v1(322.58,91.19) v1(322.58,90.42) v1(322.58,69.6) v1(322.58,68.83) v1(322.58,68.07) v1(323.34,345.95) v1(323.34,345.19) v1(323.34,344.42) v1(323.34,323.6) v1(323.34,322.83) v1(323.34,322.07) v1(323.34,295.15) v1(323.34,294.39) v1(323.34,293.62) v1(323.34,272.8) v1(323.34,272.03) v1(323.34,271.27) v1(323.34,244.35) v1(323.34,243.59) v1(323.34,242.82) v1(323.34,222) v1(323.34,221.23) v1(323.34,220.47) v1(323.34,193.55) v1(323.34,192.79) v1(323.34,192.02) v1(323.34,171.2) v1(323.34,170.43) v1(323.34,169.67) v1(323.34,142.75) v1(323.34,141.99) v1(323.34,141.22) v1(323.34,120.4) v1(323.34,119.63) v1(323.34,118.87) v1(323.34,91.95) v1(323.34,91.19) v1(323.34,90.42) v1(323.34,69.6) v1(323.34,68.83) v1(323.34,68.07) v1(324.1,345.95) v1(324.1,345.19) v1(324.1,344.42) v1(324.1,323.6) v1(324.1,322.83) v1(324.1,322.07) v1(324.1,295.15) v1(324.1,294.39) v1(324.1,293.62) v1(324.1,272.8) v1(324.1,272.03) v1(324.1,271.27) v1(324.1,244.35) v1(324.1,243.59) v1(324.1,242.82) v1(324.1,222) v1(324.1,221.23) v1(324.1,220.47) v1(324.1,193.55) v1(324.1,192.79) v1(324.1,192.02) v1(324.1,171.2) v1(324.1,170.43) v1(324.1,169.67) v1(324.1,142.75) v1(324.1,141.99) v1(324.1,141.22) v1(324.1,120.4) v1(324.1,119.63) v1(324.1,118.87) v1(324.1,91.95) v1(324.1,91.19) v1(324.1,90.42) v1(324.1,69.6) v1(324.1,68.83) v1(324.1,68.07) v1(325.63,338.84) v1(325.63,338.07) v1(325.63,337.31) v1(325.63,329.18) v1(325.63,328.42) v1(325.63,327.66) v1(325.63,288.04) v1(325.63,287.27) v1(325.63,286.51) v1(325.63,278.38) v1(325.63,277.62) v1(325.63,276.86) v1(325.63,237.24) v1(325.63,236.47) v1(325.63,235.71) v1(325.63,227.58) v1(325.63,226.82) v1(325.63,226.06) v1(325.63,186.44) v1(325.63,185.67) v1(325.63,184.91) v1(325.63,176.78) v1(325.63,176.02) v1(325.63,175.26) v1(325.63,135.64) v1(325.63,134.87) v1(325.63,134.11) v1(325.63,125.98) v1(325.63,125.22) v1(325.63,124.46) v1(325.63,84.84) v1(325.63,84.07) v1(325.63,83.31) v1(325.63,75.18) v1(325.63,74.42) v1(325.63,73.66) v1(326.39,338.84) v1(326.39,338.07) v1(326.39,337.31) v1(326.39,329.18) v1(326.39,328.42) v1(326.39,327.66) v1(326.39,288.04) v1(326.39,287.27) v1(326.39,286.51) v1(326.39,278.38) v1(326.39,277.62) v1(326.39,276.86) v1(326.39,237.24) v1(326.39,236.47) v1(326.39,235.71) v1(326.39,227.58) v1(326.39,226.82) v1(326.39,226.06) v1(326.39,186.44) v1(326.39,185.67) v1(326.39,184.91) v1(326.39,176.78) v1(326.39,176.02) v1(326.39,175.26) v1(326.39,135.64) v1(326.39,134.87) v1(326.39,134.11) v1(326.39,125.98) v1(326.39,125.22) v1(326.39,124.46) v1(326.39,84.84) v1(326.39,84.07) v1(326.39,83.31) v1(326.39,75.18) v1(326.39,74.42) v1(326.39,73.66) v1(327.15,338.84) v1(327.15,338.07) v1(327.15,337.31) v1(327.15,329.18) v1(327.15,328.42) v1(327.15,327.66) v1(327.15,288.04) v1(327.15,287.27) v1(327.15,286.51) v1(327.15,278.38) v1(327.15,277.62) v1(327.15,276.86) v1(327.15,237.24) v1(327.15,236.47) v1(327.15,235.71) v1(327.15,227.58) v1(327.15,226.82) v1(327.15,226.06) v1(327.15,186.44) v1(327.15,185.67) v1(327.15,184.91) v1(327.15,176.78) v1(327.15,176.02) v1(327.15,175.26) v1(327.15,135.64) v1(327.15,134.87) v1(327.15,134.11) v1(327.15,125.98) v1(327.15,125.22) v1(327.15,124.46) v1(327.15,84.84) v1(327.15,84.07) v1(327.15,83.31) v1(327.15,75.18) v1(327.15,74.42) v1(327.15,73.66)
